# EasyEDA Pro project ProPrj_Avaota A1 八核 AIoT 开发板_2024-05-20.epro, board 点位_TOP (continued)
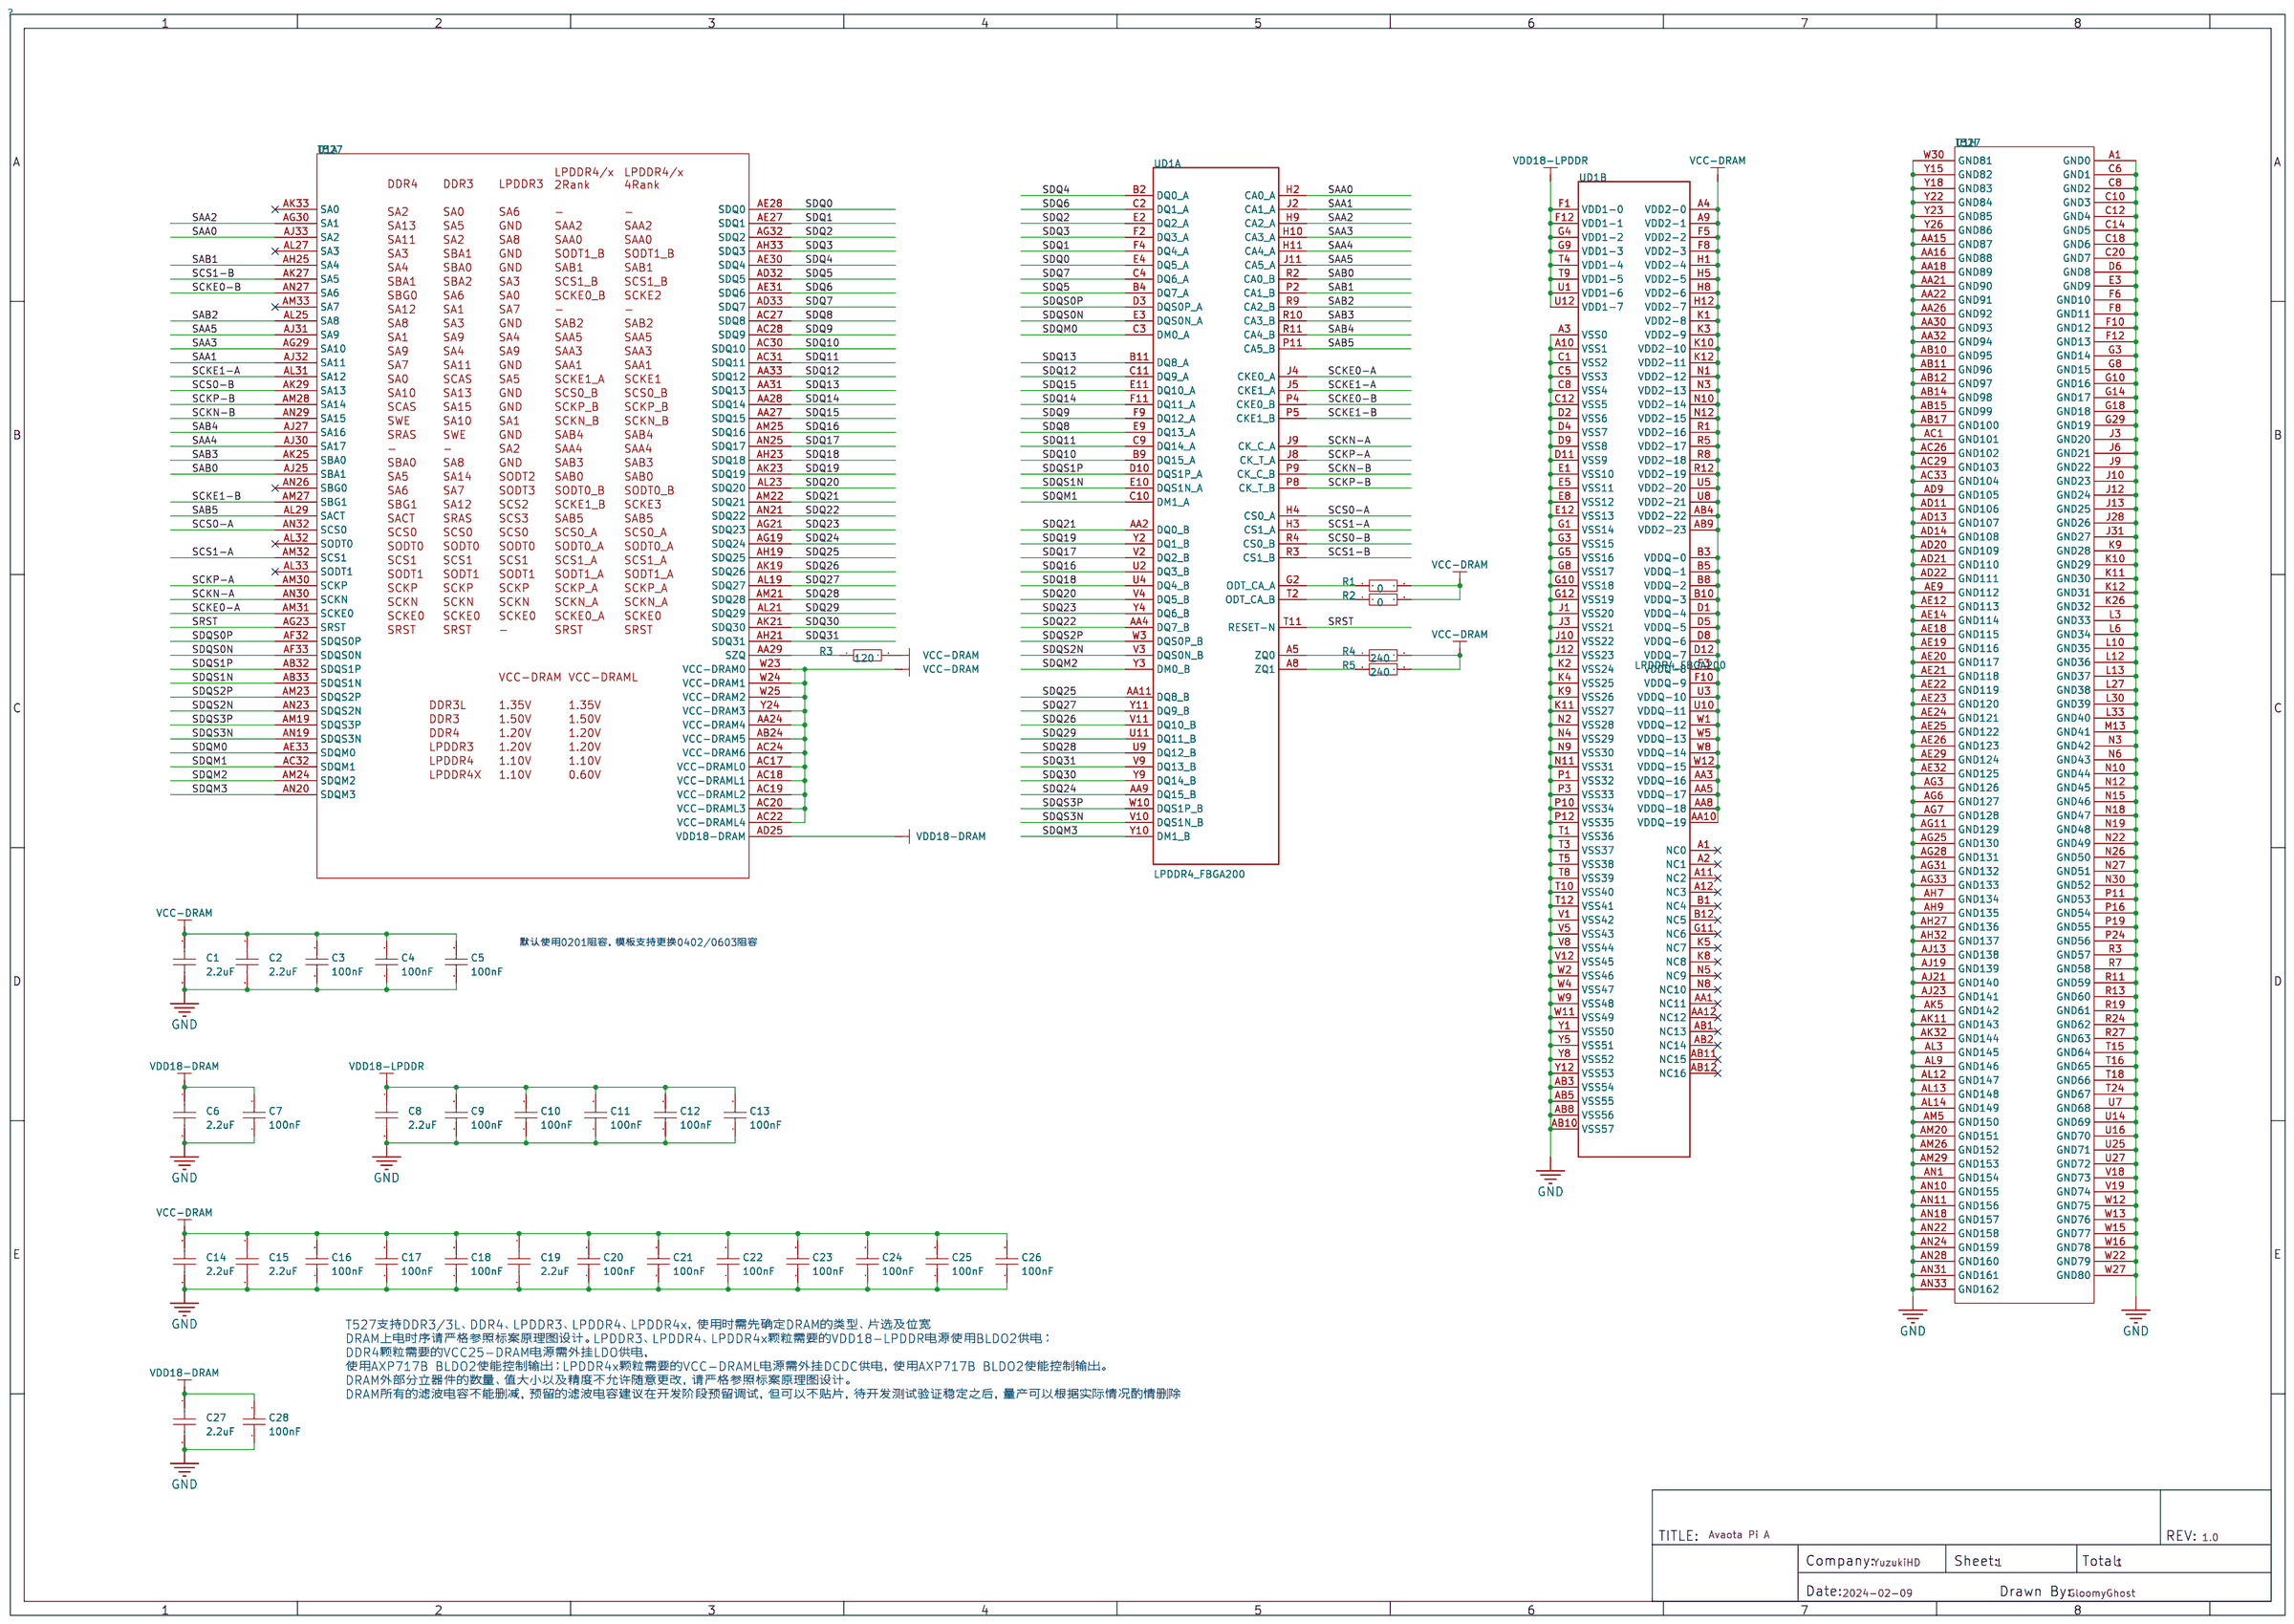
[diagram p0: schematic sheet]
## Footprints (pads in the part's own frame, mm; a bottom-side part is the same pattern mirrored in y, then rotated) (continued)
  oval 1.199x2.401 hole 1x2: 21(2.505,2.561) 22(2.505,-8.992) 23(-2.555,-11.089) 24(-2.555,0.709)
FAN2510
  round 3.5 hole 3x2.7: 1(28.321,17.053) 2(-2.54,-3.14)
FBGA-153_L13.0-W11.5
  oval 0.2x0.305 smd: A1(-3.25,3.25) A2(-2.75,3.25) A3(-2.25,3.25) A4(-1.75,3.25) A5(-1.25,3.25) A6(-0.75,3.25) A7(-0.25,3.25) A8(0.25,3.25) A9(0.75,3.25) A10(1.25,3.25) A11(1.75,3.25) A12(2.25,3.25) A13(2.75,3.25) A14(3.25,3.25) P1(-3.25,-3.25) P2(-2.75,-3.25) P3(-2.25,-3.25) P4(-1.75,-3.25) P5(-1.25,-3.25) P6(-0.75,-3.25) P7(-0.25,-3.25) P8(0.25,-3.25) P9(0.75,-3.25) P10(1.25,-3.25) P11(1.75,-3.25) P12(2.25,-3.25) P13(2.75,-3.25) P14(3.25,-3.25)
  oval 0.305x0.2 smd: B1(-3.25,2.75) B14(3.25,2.75) C1(-3.25,2.25) C14(3.25,2.25) D1(-3.25,1.75) D14(3.25,1.75) E1(-3.25,1.25) E14(3.25,1.25) F1(-3.25,0.75) F14(3.25,0.75) G1(-3.25,0.25) G14(3.25,0.25) H1(-3.25,-0.25) H14(3.25,-0.25) J1(-3.25,-0.75) J14(3.25,-0.75) K1(-3.25,-1.25) K14(3.25,-1.25) L1(-3.25,-1.75) L14(3.25,-1.75) M1(-3.25,-2.25) M14(3.25,-2.25) N1(-3.25,-2.75) N14(3.25,-2.75)
  round 0.25 smd: B2(-2.75,2.75) B3(-2.25,2.75) B4(-1.75,2.75) B5(-1.25,2.75) B6(-0.75,2.75) B7(-0.25,2.75) B8(0.25,2.75) B9(0.75,2.75) B10(1.25,2.75) B11(1.75,2.75) B12(2.25,2.75) B13(2.75,2.75) C2(-2.75,2.25) C3(-2.25,2.25) C4(-1.75,2.25) C5(-1.25,2.25) C6(-0.75,2.25) C7(-0.25,2.25) C8(0.25,2.25) C9(0.75,2.25) C10(1.25,2.25) C11(1.75,2.25) C12(2.25,2.25) C13(2.75,2.25) D2(-2.75,1.75) D3(-2.25,1.75) D4(-1.75,1.75) D12(2.25,1.75) D13(2.75,1.75) E2(-2.75,1.25) E3(-2.25,1.25) E5(-1.25,1.25) E6(-0.75,1.25) E7(-0.25,1.25) E8(0.25,1.25) E9(0.75,1.25) E10(1.25,1.25) E12(2.25,1.25) E13(2.75,1.25) F2(-2.75,0.75) F3(-2.25,0.75) F5(-1.25,0.75) F10(1.25,0.75) F12(2.25,0.75) F13(2.75,0.75) G2(-2.75,0.25) G3(-2.25,0.25) G5(-1.25,0.25) G10(1.25,0.25) G12(2.25,0.25) G13(2.75,0.25) H2(-2.75,-0.25) H3(-2.25,-0.25) H5(-1.25,-0.25) H10(1.25,-0.25) H12(2.25,-0.25) H13(2.75,-0.25) J2(-2.75,-0.75) J3(-2.25,-0.75) J5(-1.25,-0.75) J10(1.25,-0.75) J12(2.25,-0.75) J13(2.75,-0.75) K2(-2.75,-1.25) K3(-2.25,-1.25) K5(-1.25,-1.25) K6(-0.75,-1.25) K7(-0.25,-1.25) K8(0.25,-1.25) K9(0.75,-1.25) K10(1.25,-1.25) K12(2.25,-1.25) K13(2.75,-1.25) L2(-2.75,-1.75) L3(-2.25,-1.75) L12(2.25,-1.75) L13(2.75,-1.75) M2(-2.75,-2.25) M3(-2.25,-2.25) M4(-1.75,-2.25) M5(-1.25,-2.25) M6(-0.75,-2.25) M7(-0.25,-2.25) M8(0.25,-2.25) M9(0.75,-2.25) M10(1.25,-2.25) M11(1.75,-2.25) M12(2.25,-2.25) M13(2.75,-2.25) N2(-2.75,-2.75) N3(-2.25,-2.75) N4(-1.75,-2.75) N5(-1.25,-2.75) N6(-0.75,-2.75) N7(-0.25,-2.75) N8(0.25,-2.75) N9(0.75,-2.75) N10(1.25,-2.75) N11(1.75,-2.75) N12(2.25,-2.75) N13(2.75,-2.75)
HDMI-SMD_HDMI-001C
  round 0.8 hole 0.55: 1(5.3,0.5) 2(4.731,-0.5) 3(4.145,0.5) 4(3.575,-0.5) 5(2.99,0.5) 6(2.419,-0.5) 7(1.835,0.5) 8(1.264,-0.5) 9(0.68,0.5) 10(0.107,-0.5) 11(-0.475,0.5) 12(-1.049,-0.5) 13(-1.63,0.5) 14(-2.205,-0.5) 15(-2.785,0.5) 16(-3.361,-0.5) 17(-3.94,0.5) 18(-4.517,-0.5) 19(-5.095,0.5)
  oval 3.2x1.4 hole 2.7x0.9: 20(-6.05,3.25) 20(-2.95,-3.25) 20(3.45,3.25) 20(6.05,-3.25)
HDR-TH_40P-P2.54-V-M-R2-C20-S2.54
  rect 1.575x1.8 hole 1.1: 1(-24.13,-1.27)
  round 1.8 hole 1.1: 2(-24.13,1.27) 3(-21.59,-1.27) 4(-21.59,1.27) 5(-19.05,-1.27) 6(-19.05,1.27) 7(-16.51,-1.27) 8(-16.51,1.27) 9(-13.97,-1.27) 10(-13.97,1.27) 11(-11.43,-1.27) 12(-11.43,1.27) 13(-8.89,-1.27) 14(-8.89,1.27) 15(-6.35,-1.27) 16(-6.35,1.27) 17(-3.81,-1.27) 18(-3.81,1.27) 19(-1.27,-1.27) 20(-1.27,1.27) 21(1.27,-1.27) 22(1.27,1.27) 23(3.81,-1.27) 24(3.81,1.27) 25(6.35,-1.27) 26(6.35,1.27) 27(8.89,-1.27) 28(8.89,1.27) 29(11.43,-1.27) 30(11.43,1.27) 31(13.97,-1.27) 32(13.97,1.27) 33(16.51,-1.27) 34(16.51,1.27) 35(19.05,-1.27) 36(19.05,1.27) 37(21.59,-1.27) 38(21.59,1.27) 39(24.13,-1.27) 40(24.13,1.27)
IND-SMD_L2.0-W1.6
  rect 1x1.72 smd: 1(0.828,0) 2(-0.828,0)
ind-smd_l2.0-w1.6_1
  rect 1.169x1.956 smd: 1(0.889,0) 2(-0.889,0)
IND-SMD_L7.0-W6.6
  rect 2.4x3.2 smd: 1(-3,0) 2(3,0)
IPEX-SMD_BWIPX-1-001E
  rect 1.05x1 smd: 1(-0.762,0)
  rect 2.2x1.05 smd: 2(0.762,-1.475) 3(0.762,1.475)
LED-SMD_4P-L2.0-W2.0-TL_WS2812B-2020
  rect 0.9x0.7 smd: 1(-0.915,0.55) 2(-0.915,-0.55) 3(0.915,-0.55) 4(0.915,0.55)
LGA-44_L12.0-W12.0-P0.90
  rect 1.177x0.6 smd: 1(-5.843,4.5) 2(-5.843,3.6) 3(-5.843,2.7) 4(-5.843,1.8) 5(-5.843,0.9) 6(-5.843,0) 7(-5.843,-0.9) 8(-5.843,-1.8) 9(-5.843,-2.7) 10(-5.843,-3.6) 11(-5.843,-4.5) 23(5.843,-4.5) 24(5.843,-3.6) 25(5.843,-2.7) 26(5.843,-1.8) 27(5.843,-0.9) 28(5.843,0) 29(5.843,0.9) 30(5.843,1.8) 31(5.843,2.7) 32(5.843,3.6) 33(5.843,4.5)
  rect 0.6x1.177 smd: 12(-4.5,-5.843) 13(-3.6,-5.843) 14(-2.7,-5.843) 15(-1.8,-5.843) 16(-0.9,-5.843) 17(0,-5.843) 18(0.9,-5.843) 19(1.8,-5.843) 20(2.7,-5.843) 21(3.6,-5.843) 22(4.5,-5.843) 34(4.5,5.843) 35(3.6,5.843) 36(2.7,5.843) 37(1.8,5.843) 38(0.9,5.843) 39(0,5.843) 40(-0.9,5.843) 41(-1.8,5.843) 42(-2.7,5.843) 43(-3.6,5.843) 44(-4.5,5.843)
osc-smd_l3.2-w1.5 nsk
  rect 1.05x1.7 smd: 1(-1.275,0) 2(1.275,0)
Pad_e551
  round 5 hole 3.3: 54(0,0)
Pad_e553
  round 5 hole 3.3: 54(0,0)
Pad_e554
  round 5 hole 3.3: 54(0,0)
Pad_e555
  round 5 hole 3.3: 54(0,0)
Pad_e563
  round 5 hole 3.3: 54(0,0)
QFN-20_L3.0-W3.0-P0.40-BL-EP1.5
  rect 0.2x0.665 smd: 1(-0.8,-1.407) 2(-0.4,-1.407) 3(0,-1.407) 4(0.4,-1.407) 5(0.8,-1.407) 11(0.8,1.407) 12(0.4,1.407) 13(0,1.407) 14(-0.4,1.407) 15(-0.8,1.407)
  rect 0.665x0.2 smd: 6(1.407,-0.8) 7(1.407,-0.4) 8(1.407,0) 9(1.407,0.4) 10(1.407,0.8) 16(-1.407,0.8) 17(-1.407,0.4) 18(-1.407,0) 19(-1.407,-0.4) 20(-1.407,-0.8)
  rect 1.5x1.5 smd: 21(0,0)
QFN-52_L6.0-W6.0-P0.40-BL-EP3.4-1
  custom 0.2x0.585 smd: 1(-2.4,-2.917) 13(2.4,-2.917) 27(2.4,2.917) 39(-2.4,2.917)
  rect 0.2x0.585 smd: 2(-2,-2.917) 3(-1.6,-2.917) 4(-1.2,-2.917) 5(-0.8,-2.917) 6(-0.4,-2.917) 7(0,-2.917) 8(0.4,-2.917) 9(0.8,-2.917) 10(1.2,-2.917) 11(1.6,-2.917) 12(2,-2.917) 28(2,2.917) 29(1.6,2.917) 30(1.2,2.917) 31(0.8,2.917) 32(0.4,2.917) 33(0,2.917) 34(-0.4,2.917) 35(-0.8,2.917) 36(-1.2,2.917) 37(-1.6,2.917) 38(-2,2.917)
  custom 0.585x0.2 smd: 14(2.917,-2.4) 26(2.917,2.4) 40(-2.917,2.4) 52(-2.917,-2.4)
  rect 0.585x0.2 smd: 15(2.917,-2) 16(2.917,-1.6) 17(2.917,-1.2) 18(2.917,-0.8) 19(2.917,-0.4) 20(2.917,0) 21(2.917,0.4) 22(2.917,0.8) 23(2.917,1.2) 24(2.917,1.6) 25(2.917,2) 41(-2.917,2) 42(-2.917,1.6) 43(-2.917,1.2) 44(-2.917,0.8) 45(-2.917,0.4) 46(-2.917,0) 47(-2.917,-0.4) 48(-2.917,-0.8) 49(-2.917,-1.2) 50(-2.917,-1.6) 51(-2.917,-2)
  rect 3.4x3.4 smd: 53(0,0)
r0201 nsk
  rect 0.303x0.324 smd: 1(-0.241,0) 2(0.241,0)
R0402-NSK
  rect 0.5x0.559 smd: 1(-0.457,0) 2(0.458,0)
R0603 NSK
  rect 0.806x0.864 smd: 1(-0.753,0) 2(0.753,0)
RGBLED_0807
  rect 0.91x1.778 smd: 1(-0.914,0) 2(0.94,0)
RJ45-TH_HR911130A
  round 1.7 hole 1.1: 11(6.604,6.924) 12(4.064,6.924) 13(-4.064,6.924) 14(-6.604,6.924)
  rect 1.524x1.524 hole 0.909: P1(5.832,-6.924)
  round 1.524 hole 0.909: P2(4.549,-4.379) P3(3.18,-6.919) P4(2.009,-4.379) P5(0.64,-6.919) P6(-0.531,-4.379) P7(-1.9,-6.919) P8(-3.071,-4.379) P9(-4.44,-6.919) P10(-5.611,-4.379)
  round 2.159 hole 1.651: SHIELD0(-8.001,-1.079) SHIELD1(8.001,-1.079)
SENSOR-SMD_IRM-H638T-TR2-TL
  rect 1.5x0.9 smd: 1(-2.95,1.27) 2(-2.95,-1.27) 3(2.95,-1.27) 4(2.921,1.27)
SLP2510P8_L2.5-W1.0-P0.50-BL
  rect 0.2x0.68 smd: 1(-1,-0.44) 2(-0.5,-0.44) 4(0.5,-0.44) 5(1,-0.44) 6(1,0.44) 7(0.5,0.44) 9(-0.5,0.44) 10(-1,0.44)
  rect 0.4x0.68 smd: 3(0.001,-0.44) 8(0.001,0.44)
SMA_L4.4-W2.8-LS5.4-R-RD
  rect 2.062x1.539 smd: 1(2.503,0) 2(-2.503,0)
SMC_L6.9-W5.9-LS7.9-BI
  rect 3.03x3.82 smd: 1(-3.435,0) 2(3.435,0)
SOD-323_L1.8-W1.3-LS2.5-RD
  rect 1x0.75 smd: 1(-1.173,0) 2(1.173,0)
SOD-523_L1.2-W0.8-LS1.6-RD-1 NSK
  rect 0.6x0.36 smd: 1(-0.635,0) 2(0.635,0)
SOIC-8_L5.0-W4.0-P1.27-LS6.0-BL-EP2.0
  oval 0.574x2.038 smd: 1(-1.905,-2.769) 2(-0.635,-2.769) 3(0.635,-2.769) 4(1.905,-2.769) 5(1.905,2.769) 6(0.635,2.769) 7(-0.635,2.769) 8(-1.905,2.769)
  rect 2x2 smd: 9(0,0)
SOT-23-3_L2.9-W1.3-P1.90-LS2.4-BR
  rect 1.25x0.7 smd: 1(1,-0.95) 2(1,0.95) 3(-1,0)
SOT-23-5_L3.0-W1.7-P0.95-LS2.8-BL
  rect 0.49x1.157 smd: 1(-0.95,-1.153) 2(0,-1.153) 3(0.95,-1.153)
  rect 0.49x1.175 smd: 4(0.95,1.153) 5(-0.95,1.153)
SW-SMD_4P-L4.2-W3.4-P2.15-LS4.5-TL
  rect 1.05x0.7 smd: 1(-2.1,1.075) 2(2.1,1.075) 3(-2.1,-1.075) 4(2.1,-1.075)
t527-bga664
  round 0.229 smd: A1(-8,8) A2(-7.5,8) A3(-7,8) A4(-6.5,8) A5(-6,8) A6(-5.5,8) A8(-4.5,8) A10(-3.5,8) A12(-2.5,8) A14(-1.5,8) A16(-0.5,8) A18(0.5,8) A20(1.5,8) A22(2.5,8) A24(3.5,8) A26(4.5,8) A28(5.5,8) A29(6,8) A30(6.5,8) A31(7,8) A32(7.5,8) A33(8,8) AA1(-8,-2) AA2(-7.5,-2) AA3(-7,-2) AA4(-6.5,-2) AA5(-6,-2) AA6(-5.5,-2) AA7(-5,-2) AA9(-4,-2) AA12(-2.5,-2) AA13(-2,-2) AA15(-1,-2) AA16(-0.5,-2) AA18(0.5,-2) AA19(1,-2) AA21(2,-2) AA22(2.5,-2) AA24(3.5,-2) AA26(4.5,-2) AA27(5,-2) AA28(5.5,-2) AA29(6,-2) AA30(6.5,-2) AA31(7,-2) AA32(7.5,-2) AA33(8,-2) AB2(-7.5,-2.501) AB3(-7,-2.5) AB9(-4,-2.501) AB10(-3.5,-2.5) AB11(-3,-2.5) AB12(-2.5,-2.5) AB13(-2,-2.5) AB14(-1.5,-2.5) AB15(-1,-2.5) AB17(0,-2.5) AB24(3.5,-2.5) AB32(7.5,-2.501) AB33(8,-2.5) AC1(-8,-3) AC2(-7.5,-3) AC3(-7,-3) AC4(-6.5,-3) AC5(-6,-3) AC6(-5.5,-3) AC7(-5,-3) AC9(-4,-3) AC15(-1,-3) AC17(0,-3) AC18(0.5,-3) AC19(1,-3) AC20(1.5,-3) AC22(2.5,-3) AC24(3.5,-3) AC26(4.5,-3) AC27(5,-3) AC28(5.5,-3) AC29(6,-3) AC30(6.5,-3) AC31(7,-3) AC32(7.5,-3) AC33(8,-3) AD1(-8,-3.5) AD2(-7.5,-3.5) AD9(-4,-3.5) AD11(-3,-3.5) AD13(-2,-3.5) AD14(-1.5,-3.5) AD15(-1,-3.5) AD20(1.5,-3.5) AD21(2,-3.5) AD22(2.5,-3.5) AD25(4,-3.5) AD32(7.5,-3.5) AD33(8,-3.5) AE1(-8,-4) AE2(-7.5,-4) AE3(-7,-4) AE4(-6.5,-4) AE5(-6,-4) AE6(-5.5,-4) AE7(-5,-4) AE9(-4,-4) AE11(-3,-4) AE12(-2.501,-4) AE13(-2,-4) AE14(-1.5,-4) AE16(-0.5,-4) AE18(0.5,-4) AE19(1,-4) AE20(1.5,-4) AE21(2,-4) AE22(2.501,-4) AE23(3,-4) AE24(3.5,-4) AE25(4,-4) AE26(4.5,-4) AE27(5,-4) AE28(5.5,-4) AE29(6,-4) AE30(6.5,-4) AE31(7,-4) AE32(7.5,-4) AE33(8,-4) AF1(-8,-4.5) AF2(-7.5,-4.5) AF32(7.5,-4.5) AF33(8,-4.5) AG1(-8,-5) AG2(-7.5,-5) AG3(-7,-5) AG4(-6.5,-5) AG5(-6,-5) AG6(-5.5,-5) AG7(-5,-5) AG9(-4,-5) AG11(-3,-5) AG13(-2,-5) AG15(-1,-5) AG17(0,-5) AG19(1,-5) AG21(2,-5) AG23(3,-5) AG25(4,-5) AG28(5.5,-5) AG29(6,-5) AG30(6.5,-5) AG31(7,-5) AG32(7.5,-5) AG33(8,-5) AH1(-8,-5.5) AH2(-7.5,-5.5) AH7(-5,-5.5) AH9(-4,-5.5) AH11(-3,-5.5) AH13(-2,-5.5) AH15(-1,-5.5) AH17(0,-5.5) AH19(1,-5.5) AH21(2,-5.5) AH23(3,-5.5) AH25(4,-5.5) AH27(5,-5.5) AH32(7.5,-5.5) AH33(8,-5.5) AJ1(-8,-6) AJ2(-7.5,-6) AJ3(-7,-6) AJ4(-6.5,-6) AJ5(-6,-6) AJ7(-5,-6) AJ9(-4,-6) AJ11(-3,-6) AJ13(-2,-6) AJ15(-1,-6) AJ17(0,-6) AJ19(1,-6) AJ21(2,-6) AJ23(3,-6) AJ25(4,-6) AJ27(5,-6) AJ30(6.5,-6) AJ31(7,-6) AJ32(7.5,-6) AJ33(8,-6) AK1(-8,-6.5) AK2(-7.5,-6.5) AK5(-6,-6.5) AK7(-5,-6.5) AK9(-4,-6.5) AK11(-3,-6.5) AK13(-2,-6.5) AK15(-1,-6.5) AK17(0,-6.5) AK19(1,-6.5) AK21(2,-6.5) AK23(3,-6.5) AK25(4,-6.5) AK27(5,-6.5) AK29(6,-6.5) AK32(7.5,-6.5) AK33(8,-6.5) AL1(-8,-7) AL2(-7.5,-7) AL3(-7,-7) AL5(-6,-7) AL7(-5,-7) AL9(-4,-7) AL11(-3,-7) AL12(-2.5,-7) AL13(-2,-7) AL14(-1.5,-7) AL15(-1,-7) AL16(-0.5,-7) AL17(0,-7) AL19(1,-7) AL21(2,-7) AL23(3,-7) AL25(4,-7) AL27(5,-7) AL29(6,-7) AL31(7,-7) AL32(7.5,-7) AL33(8,-7) AM1(-8,-7.5) AM2(-7.5,-7.5) AM3(-7,-7.5) AM4(-6.5,-7.5) AM5(-6,-7.5) AM6(-5.5,-7.5) AM7(-5,-7.5) AM8(-4.5,-7.5) AM9(-4,-7.5) AM10(-3.5,-7.5) AM11(-3,-7.5) AM12(-2.501,-7.5) AM13(-2,-7.5) AM14(-1.5,-7.5) AM15(-1,-7.5) AM16(-0.5,-7.5) AM17(0,-7.5) AM18(0.5,-7.5) AM19(1,-7.5) AM20(1.5,-7.5) AM21(2,-7.5) AM22(2.501,-7.5) AM23(3,-7.5) AM24(3.5,-7.5) AM25(4,-7.5) AM26(4.5,-7.5) AM27(5,-7.5) AM28(5.5,-7.5) AM29(6,-7.5) AM30(6.5,-7.5) AM31(7,-7.5) AM32(7.5,-7.5) AM33(8,-7.5) AN1(-8,-8) AN2(-7.5,-8) AN3(-7,-8) AN4(-6.5,-8) AN5(-6,-8) AN6(-5.5,-8) AN7(-5,-8) AN8(-4.5,-8) AN9(-4,-8) AN10(-3.5,-8) AN11(-3,-8) AN13(-2,-8) AN15(-1,-8) AN17(0,-8) AN18(0.5,-8) AN19(1,-8) AN20(1.5,-8) AN21(2,-8) AN22(2.5,-8) AN23(3,-8) AN24(3.5,-8) AN25(4,-8) AN26(4.5,-8) AN27(5,-8) AN28(5.5,-8) AN29(6,-8) AN30(6.5,-8) AN31(7,-8) AN32(7.5,-8) AN33(8,-8) B1(-8,7.5) B2(-7.5,7.5) B3(-7,7.5) B4(-6.5,7.5) B5(-6,7.5) B6(-5.5,7.5) B7(-5,7.5) B8(-4.5,7.5) B9(-4,7.5) B10(-3.5,7.5) B11(-3,7.5) B12(-2.501,7.5) B13(-2,7.5) B14(-1.5,7.5) B15(-1,7.5) B16(-0.5,7.5) B17(0,7.5) B18(0.5,7.5) B19(1,7.5) B20(1.5,7.5) B21(2,7.5) B22(2.501,7.5) B23(3,7.5) B24(3.5,7.5) B25(4,7.5) B26(4.5,7.5) B27(5,7.5) B28(5.5,7.5) B29(6,7.5) B30(6.5,7.5) B31(7,7.5) B32(7.5,7.5) B33(8,7.5) C1(-8,7) C2(-7.5,7) C3(-7,7) C4(-6.5,7) C6(-5.5,7) C7(-5,7) C8(-4.5,7) C9(-4,7) C10(-3.5,7) C11(-3,7) C12(-2.5,7) C13(-2,7) C14(-1.5,7) C15(-1,7) C16(-0.5,7) C17(0,7) C18(0.5,7) C19(1,7) C20(1.5,7) C21(2,7) C22(2.5,7) C23(3,7) C24(3.5,7) C25(4,7) C26(4.5,7) C27(5,7) C28(5.5,7) C29(6,7) C30(6.5,7) C31(7,7) C32(7.5,7) C33(8,7) D1(-8,6.5) D2(-7.5,6.5) D6(-5.5,6.5) D8(-4.5,6.5) D10(-3.5,6.5) D12(-2.5,6.5) D14(-1.5,6.5) D16(-0.5,6.5) D18(0.5,6.5) D20(1.5,6.5) D22(2.5,6.5) D24(3.5,6.5) D26(4.5,6.5) D28(5.5,6.5) D32(7.5,6.5) D33(8,6.5) E1(-8,6) E2(-7.5,6) E3(-7,6) E4(-6.5,6) E5(-6,6) E6(-5.5,6) E8(-4.5,6) E10(-3.5,6) E12(-2.5,6) E14(-1.5,6) E16(-0.5,6) E18(0.5,6) E20(1.5,6) E22(2.5,6) E24(3.5,6) E26(4.5,6) E28(5.5,6) E29(6,6) E30(6.5,6) E31(7,6) E32(7.5,6) E33(8,6) F1(-8,5.5) F2(-7.5,5.5) F6(-5.5,5.5) F8(-4.5,5.5) F10(-3.5,5.5) F12(-2.5,5.5) F14(-1.5,5.5) F16(-0.5,5.5) F18(0.5,5.5) F20(1.5,5.5) F22(2.5,5.5) F24(3.5,5.5) F26(4.5,5.5) F28(5.5,5.5) F32(7.5,5.5) F33(8,5.5) G1(-8,5) G2(-7.5,5) G3(-7,5) G4(-6.5,5) G5(-6,5) G6(-5.5,5) G8(-4.5,5) G10(-3.5,5) G12(-2.5,5) G14(-1.5,5) G16(-0.5,5) G18(0.5,5) G20(1.5,5) G22(2.5,5) G24(3.5,5) G26(4.5,5) G28(5.5,5) G29(6,5) G30(6.5,5) G31(7,5) G32(7.5,5) G33(8,5) H2(-7.5,4.5) H3(-7,4.5) H24(3.5,4.5) H31(7,4.5) H32(7.5,4.5) J1(-8,4) J2(-7.5,4) J3(-7,4) J4(-6.5,4) J5(-6,4) J6(-5.5,4) J7(-5,4) J9(-4,4) J10(-3.5,4) J12(-2.501,4) J13(-2,4) J15(-1,4) J16(-0.5,4) J17(0,4) J18(0.5,4) J19(1,4) J21(2,4) J22(2.501,4) J23(3,4) J26(4.5,4) J28(5.5,4) J29(6,4) J30(6.5,4) J31(7,4) J32(7.5,4) J33(8,4) K2(-7.5,3.5) K3(-7,3.5) K9(-4,3.5) K10(-3.5,3.5) K11(-3,3.5) K12(-2.5,3.5) K13(-2,3.5) K15(-1,3.5) K16(-0.5,3.5) K19(1,3.5) K21(2,3.5) K22(2.5,3.5) K24(3.5,3.5) K25(4,3.5) K26(4.5,3.5) K31(7,3.5) K32(7.5,3.5) L1(-8,3) L2(-7.5,3) L3(-7,3) L4(-6.5,3) L5(-6,3) L6(-5.5,3) L7(-5,3) L9(-4,3) L10(-3.5,3) L12(-2.5,3) L13(-2,3) L15(-1,3) L16(-0.5,3) L17(0,3) L18(0.5,3) L19(1,3) L21(2,3) L22(2.5,3) L24(3.5,3) L26(4.5,3) L27(5,3) L28(5.5,3) L29(6,3) L30(6.5,3) L31(7,3) L32(7.5,3) L33(8,3) M2(-7.5,2.501) M3(-7,2.5) M10(-3.5,2.5) M13(-2,2.5) M16(-0.5,2.5) M18(0.5,2.5) M19(1,2.5) M21(2,2.5) M22(2.5,2.5) M31(7,2.5) M32(7.5,2.501) N1(-8,2) N2(-7.5,2) N3(-7,2) N4(-6.5,2) N5(-6,2) N6(-5.5,2) N7(-5,2) N9(-4,2) N10(-3.5,2) N12(-2.5,2) N13(-2,2) N15(-1,2) N18(0.5,2) N19(1,2) N21(2,2) N22(2.5,2) N24(3.5,2) N26(4.5,2) N27(5,2) N28(5.5,2) N29(6,2) N30(6.5,2) N31(7,2) N32(7.5,2) N33(8,2) P2(-7.5,1.5) P3(-7,1.5) P9(-4,1.5) P11(-3,1.5) P13(-2,1.5) P16(-0.5,1.5) P18(0.5,1.5) P19(1,1.5) P21(2,1.5) P22(2.5,1.5) P24(3.5,1.5) P31(7,1.5) P32(7.5,1.5) R1(-8,1) R2(-7.5,1) R3(-7,1) R4(-6.5,1) R5(-6,1) R6(-5.5,1) R7(-5,1) R11(-3,1) R13(-2,1) R15(-1,1) R17(0,1) R18(0.5,1) R19(1,1) R22(2.5,1) R24(3.5,1) R26(4.5,1) R27(5,1) R28(5.5,1) R29(6,1) R30(6.5,1) R31(7,1) R32(7.5,1) R33(8,1) T2(-7.5,0.5) T3(-7,0.5) T9(-4,0.5) T11(-3,0.5) T13(-2,0.5) T15(-1,0.5) T16(-0.5,0.5) T18(0.5,0.5) T19(1,0.5) T21(2,0.5) T22(2.5,0.5) T24(3.5,0.5) T31(7,0.5) T32(7.5,0.5) U1(-8,0) U2(-7.5,0) U3(-7,0) U4(-6.5,0) U5(-6,0) U6(-5.5,0) U7(-5,0) U8(-4.5,0) U10(-3.5,0) U12(-2.5,0) U13(-2,0) U14(-1.5,0) U16(-0.5,0) U18(0.5,0) U19(1,0) U21(2,0) U22(2.5,0) U25(4,0) U26(4.5,0) U27(5,0) U28(5.5,0) U29(6,0) U30(6.5,0) U31(7,0) U32(7.5,0) U33(8,0) V2(-7.5,-0.5) V3(-7,-0.5) V18(0.5,-0.5) V19(1,-0.5) V31(7,-0.5) V32(7.5,-0.5) W1(-8,-1) W2(-7.5,-1) W3(-7,-1) W4(-6.5,-1) W5(-6,-1) W6(-5.5,-1) W7(-5,-1) W9(-4,-1) W10(-3.5,-1) W12(-2.5,-1) W13(-2,-1) W15(-1,-1) W16(-0.5,-1) W19(1,-1) W21(2,-1) W22(2.5,-1) W23(3,-1) W24(3.5,-1) W25(4,-1) W27(5,-1) W28(5.5,-1) W29(6,-1) W30(6.5,-1) W31(7,-1) W32(7.5,-1) W33(8,-1) Y2(-7.5,-1.5) Y3(-7,-1.5) Y9(-4,-1.5) Y10(-3.5,-1.5) Y12(-2.5,-1.5) Y13(-2,-1.5) Y15(-1,-1.5) Y18(0.5,-1.5) Y19(1,-1.5) Y21(2,-1.5) Y22(2.5,-1.5) Y23(3,-1.5) Y24(3.5,-1.5) Y26(4.5,-1.5) Y31(7,-1.5) Y32(7.5,-1.5)
TFT_1.14寸_0.7MM-13P
  oval 4x0.35 smd: 1(2.65,4.2) 2(2.65,3.5) 3(2.65,2.8) 4(2.65,2.1) 5(2.65,1.4) 6(2.65,0.7) 7(2.65,0) 8(2.65,-0.7) 9(2.65,-1.4) 10(2.65,-2.1) 11(2.65,-2.8) 12(2.65,-3.5) 13(2.65,-4.2)
USB-A-TH_XUNPU_USB-303WSD-BRY
  round 1.1 hole 0.7: 1(-3.5,-1.35) 2(-1,-1.35) 3(1,-1.35) 4(3.5,-1.35) 5(4,0.15) 6(2,0.15) 7(0,0.15) 8(-2,0.15) 9(-4,0.15) 10(-3.5,1.85) 11(-1,1.85) 12(1,1.85) 13(3.5,1.85) 14(4,3.35) 15(2,3.35) 16(0,3.35) 17(-2,3.35) 18(-4,3.35)
  round 3.2 hole 2.4: 19(6.57,-3.35) 20(6.57,2.33) 21(-6.57,2.33) 22(-6.57,-3.35)
USB-C-SMD_TYPEC-304-BCP16-1
  oval 1x2.1 hole 0.6x1.7: 12(-4.32,1.633) 13(4.32,1.633)
  oval 1x1.6 hole 0.6x1.2: 14(-4.32,-2.547) 15(4.32,-2.547)
  rect 0.55x1.45 smd: A1B12(-3.225,2.547) A4B9(-2.45,2.547) B1A12(3.225,2.547) B4A9(2.45,2.547)
  rect 0.3x1.45 smd: A5(-1.25,2.547) A6(-0.25,2.547) A7(0.25,2.547) A8(1.25,2.547) B5(1.75,2.547) B6(0.75,2.547) B7(-0.75,2.547) B8(-1.75,2.547)
WQFN-40_L5.0-W5.0-P0.4-BL-EP
  oval 0.2x0.8 smd: 1(-1.801,-2.499) 2(-1.399,-2.499) 3(-1.001,-2.499) 4(-0.6,-2.499) 5(-0.201,-2.499) 6(0.201,-2.499) 7(0.6,-2.499) 8(1.001,-2.499) 9(1.399,-2.499) 10(1.801,-2.499) 21(1.801,2.499) 22(1.399,2.499) 23(1.001,2.499) 24(0.6,2.499) 25(0.201,2.499) 26(-0.201,2.499) 27(-0.6,2.499) 28(-1.001,2.499) 29(-1.399,2.499) 30(-1.801,2.499)
  oval 0.8x0.2 smd: 11(2.499,-1.801) 12(2.499,-1.399) 13(2.499,-1.001) 14(2.499,-0.6) 15(2.499,-0.201) 16(2.499,0.201) 17(2.499,0.6) 18(2.499,1.001) 19(2.499,1.399) 20(2.499,1.801) 31(-2.499,1.801) 32(-2.499,1.399) 33(-2.499,1.001) 34(-2.499,0.6) 35(-2.499,0.201) 36(-2.499,-0.201) 37(-2.499,-0.6) 38(-2.499,-1.001) 39(-2.499,-1.399) 40(-2.499,-1.801)
  rect 3.8x3.8 smd: 41(0,0)

## Nets
AGND: U14.AE3
GND: C1.1 C2.1 C3.1 C5.1 C6.1 C7.1 C8.1 C10.2 C11.2 C12.2 C15.1 C16.1 C17.2 C18.1 C25.1 C27.1 C28.1 C31.1 C33.1 C35.1 C43.2 C44.1 C45.1 C51.2 C52.2 C53.2 C54.2 C55.2 C59.2 C60.1 C61.2 C62.1 C63.2 C64.1 C65.2 C66.1 C69.2 C70.1 C71.2 C72.1 C73.2 C74.1 C80.1 C81.1 C87.1 C88.2 C89.1 C95.1 C96.1 C97.1 C98.1 C99.1 C100.1 C101.1 C131.1 C136.1 C139.1 C140.1 C146.1 C147.2 C148.1 C149.1 C150.1 C157.1 C158.1 C159.1 C160.1 C179.1 C180.1 C189.1 C210.1 C218.1 C221.1 C222.1 C244.1 C245.1 C249.2 C250.2 C251.1 C252.1 C253.2 C254.2 C256.2 C257.1 C258.2 C259.1 C260.2 C261.2 C262.2 C263.2 C264.2 C265.2 C266.2 C267.2 C268.1 C269.2 C270.2 C271.2 C272.2 C273.2 C274.2 C275.1 C280.1 C281.1 C282.1 C283.1 C284.1 C290.1 C291.1 C292.1 C293.1 CGQ1.1 CGQ1.2 CN3.3 CN3.4 CN4.1 CN4.3 CN4.4 D2.1 D4.1 D5.3 D5.8 D6.3 D6.8 D8.3 D8.8 D10.3 D10.8 D11.3 D11.8 D12.3 D12.8 D13.3 D13.8 D14.3 D14.8 D15.3 D15.8 D24.1 D25.1 D26.1 D27.1 D30.1 D31.1 DC1.2 DC1.3 FEL1.1 H1.6 H1.9 H1.14 H1.20 H1.25 H1.30 H1.34 H1.39 LED1.2 LED2.2 LED3.2 LED4.2 LED5.2 NOREF.54 NOREF#2.54 NOREF#3.54 NOREF#4.54 NOREF#5.54 PWR1.1 R2.1 R6.1 R7.2 R8.1 R13.1 R33.1 R34.1 R35.1 R60.1 R62.1 R82.1 R85.1 R86.1 R93.1 R94.1 R95.1 R96.1 R100.1 R103.1 R104.1 R111.1 R112.1 R113.1 R114.1 R117.2 R118.1 R121.1 R129.1 R130.1 RESET1.1 RF1.2 RF1.3 RJ1.P10 RJ1.SHIELD0 RJ1.SHIELD1 RJ2.P10 RJ2.SHIELD0 RJ2.SHIELD1 TFT1.8 TFT1.11 TFT1.13 U1.2 U2.2 U3.7 U3.9 U4.8 U4.53 U5.9 U5.21 U8.A6 U8.C4 U8.E7 U8.G5 U8.H10 U8.J5 U8.K8 U8.N2 U8.N5 U8.P4 U8.P6 U9.1 U9.3 U9.20 U9.31 U9.33 U9.36 U12.41 U13.41 U14.A1 U14.A32 U14.A33 U14.AA7 U14.AA15 U14.AA16 U14.AA18 U14.AA21 U14.AA22 U14.AA26 U14.AA30 U14.AA32 U14.AB10 U14.AB11 U14.AB12 U14.AB14 U14.AB15 U14.AB17 U14.AC1 U14.AC26 U14.AC29 U14.AC33 U14.AD9 U14.AD11 U14.AD13 U14.AD14 U14.AD20 U14.AD21 U14.AD22 U14.AE9 U14.AE12 U14.AE14 U14.AE18 U14.AE19 U14.AE20 U14.AE21 U14.AE22 U14.AE23 U14.AE24 U14.AE25 U14.AE26 U14.AE29 U14.AE32 U14.AG3 U14.AG6 U14.AG7 U14.AG11 U14.AG25 U14.AG28 U14.AG31 U14.AG33 U14.AH7 U14.AH9 U14.AH27 U14.AH32 U14.AJ13 U14.AJ19 U14.AJ21 U14.AJ23 U14.AK5 U14.AK11 U14.AK32 U14.AL3 U14.AL9 U14.AL12 U14.AL13 U14.AL14 U14.AM5 U14.AM20 U14.AM26 U14.AM29 U14.AN1 U14.AN10 U14.AN11 U14.AN18 U14.AN22 U14.AN24 U14.AN28 U14.AN31 U14.AN33 U14.B21 U14.C6 U14.C8 U14.C10 U14.C12 U14.C14 U14.C18 U14.C20 U14.C21 U14.C22 U14.C24 U14.C26 U14.C28 U14.C30 U14.C31 U14.D6 U14.E3 U14.E29 U14.F6 U14.F8 U14.F10 U14.F12 U14.F22 U14.F24 U14.G3 U14.G8 U14.G10 U14.G14 U14.G18 U14.G26 U14.G28 U14.G29 U14.H24 U14.J3 U14.J6 U14.J9 U14.J10 U14.J12 U14.J13 U14.J17 U14.J21 U14.J22 U14.J23 U14.J26 U14.J28 U14.J31 U14.K9 U14.K10 U14.K11 U14.K12 U14.K15 U14.K16 U14.K21 U14.K22 U14.K24 U14.K25 U14.K26 U14.L3 U14.L6 U14.L10 U14.L12 U14.L13 U14.L16 U14.L19 U14.L24 U14.L27 U14.L30 U14.L33 U14.M13 U14.M16 U14.M18 U14.M19 U14.N3 U14.N6 U14.N10 U14.N12 U14.N15 U14.N18 U14.N19 U14.N22 U14.N26 U14.N27 U14.N30 U14.P11 U14.P16 U14.P19 U14.P24 U14.R3 U14.R7 U14.R11 U14.R13 U14.R19 U14.R24 U14.R27 U14.T15 U14.T16 U14.T18 U14.T24 U14.U7 U14.U14 U14.U16 U14.U25 U14.U27 U14.V18 U14.V19 U14.W12 U14.W13 U14.W15 U14.W16 U14.W22 U14.W27 U14.W30 U14.Y10 U14.Y15 U14.Y18 U14.Y22 U14.Y23 U14.Y26 U15.2 U15.5 U15.8 U15.11 U15.16 U15.19 U15.21 U15.22 U15.23 U15.24 U17.2 UD1.A3 UD1.A10 UD1.AB3 UD1.AB5 UD1.AB8 UD1.AB10 UD1.C1 UD1.C5 UD1.C8 UD1.C12 UD1.D2 UD1.D4 UD1.D9 UD1.D11 UD1.E1 UD1.E5 UD1.E8 UD1.E12 UD1.G1 UD1.G3 UD1.G5 UD1.G8 UD1.G10 UD1.G12 UD1.J1 UD1.J3 UD1.J10 UD1.J12 UD1.K2 UD1.K4 UD1.K9 UD1.K11 UD1.N2 UD1.N4 UD1.N9 UD1.N11 UD1.P1 UD1.P3 UD1.P10 UD1.P12 UD1.T1 UD1.T3 UD1.T5 UD1.T8 UD1.T10 UD1.T12 UD1.V1 UD1.V5 UD1.V8 UD1.V12 UD1.W2 UD1.W4 UD1.W9 UD1.W11 UD1.Y1 UD1.Y5 UD1.Y8 UD1.Y12 USB1.2 USB1.5 USB1.8 USB1.11 USB1.14 USB1.17 USB1.20 USB2.4 USB2.7 USB2.13 USB2.16 USB2.19 USB2.20 USB2.21 USB2.22 USB3.12 USB3.13 USB3.14 USB3.15 USB3.A1B12 USB3.B1A12 X1.2 X1.4 X3.2 X3.4 X4.2 X4.4
VBUS: C27.2 C28.2 C221.2 C222.2 C280.2 D1.2 D3.2 D9.2 H1.2 H1.4 LED2.4 LED3.4 LED4.4 LED5.4 R52.1 R53.1 U4.49 U4.50 U17.5 USB2.1 USB2.10
VBUS-USB: C281.2 C282.2 R120.2 U17.1 USB3.A4B9 USB3.B4A9
VCC-LDO-RTC: C45.2 R9.1 R10.1 U4.35 U14.AE13
VDD-CPUBFB: U5.1 U5.16 U14.R22
VDD-CPULFB: U4.12 U14.AA19
VDD-DNRFB: U5.4 U14.AB13
VDD-SYSFB: U4.34 U14.P18
323-ALDO1: C69.1 U5.15
323-DCDC1/2: C72.2 C74.2 C80.2 C81.2 L6.2 L7.2 U14.T19 U14.T21 U14.T22 U14.U18 U14.U19 U14.U21 U14.U22
323-DCDC3: C87.2 C89.2 L8.2 U14.AA12 U14.AA13 U14.Y12 U14.Y13
323-DLDO1: C71.1 U5.12
323-RTCLDO: C73.1 U5.7
ADCIN0: U14.W9
ADCIN1: U14.W10
ALDO1: C51.1 U4.13
ALDO2: C52.1 U4.14
ALDO3: C53.1 R11.1 R12.1 U4.16 U14.AE11 U14.AG9
ALDO4: C54.1 R19.2 R20.2 R30.2 R31.2 R32.2 U4.17 U14.AB9 U14.AD15 U14.AD25 U14.AG15 U14.W7
ALDO-OUT: U14.AE7
AP-NMI: R10.2 U4.37 U5.11 U14.AM10
AP-RESET: C95.2 R9.2 R21.2 U4.1 U5.13 U14.AJ11
AP-WAKE-BT: R69.2 U9.6 U14.U4
AXP717-CC1: D24.2 R130.2 USB3.A5
AXP717-CC2: D31.2 R129.2 USB3.B5
BLDO1: C59.1 C179.2 C180.2 R69.1 R70.1 U4.18 U9.22 U14.N9 U14.N24 U14.T9
BLDO2: C61.1 C136.2 C139.2 C140.2 U4.19 U5.14 UD1.F1 UD1.F12 UD1.G4 UD1.G9 UD1.T4 UD1.T9 UD1.U1 UD1.U12
BLDO3: C63.1 U4.21 U14.AJ5 U14.J15 U14.K13 U14.L22 U14.M10 U14.M21
BLDO4: C65.1 U4.22
BOOT-SEL-ADC: R30.1 R33.2 U14.W1
BT-RESETN: U9.34 U14.U3
BT-WAKE-AP: R70.2 U9.7 U14.U5
CAN-RX0: U14.AJ17
CAN-TX0: U14.AH17
CLDO1: C60.2 U4.23 U8.C6 U8.M4 U8.N4 U8.P3 U8.P5 U14.U26
CLDO2: C62.2 U4.24 U14.R26
CLDO3: C64.2 R47.1 U4.26 U8.E6 U8.F5 U8.J10 U8.K9 U14.AC9
CLDO4: C66.2 U4.27
CPUSLDO: C35.2 U4.28 U14.AC15
CPUX-RX: D30.2 H1.10 U14.R29 USB3.B8
CPUX-TX: D27.2 H1.8 U14.R28 USB3.A8
CPVDD: U14.AJ3
CPVEE: U14.AJ4 U14.AK2
CTP-INT: U14.R31
CTP-RST: U14.R30
CTP-SCK: U14.R32
CTP-SDA: U14.R33
DCDC1: C15.2 C16.2 L2.2 U14.W19 U14.W21 U14.Y19 U14.Y21
DCDC2: C18.2 C25.2 C210.2 C218.2 C290.2 C291.2 L3.2 U14.J16 U14.L18 U14.L21 U14.M22 U14.N13 U14.N21 U14.P13 U14.P21 U14.P22 U14.R15 U14.R17 U14.R18 U14.T11 U14.T13 U14.U12 U14.U13
DCDC3: C31.2 C33.2 C131.2 C146.2 C147.1 C148.2 C149.2 C150.2 C157.2 C158.2 C159.2 C160.2 C292.2 C293.2 L4.2 R36.2 R37.2 U4.29 U14.AA24 U14.AB24 U14.AC17 U14.AC18 U14.AC19 U14.AC20 U14.AC22 U14.AC24 U14.W23 U14.W24 U14.W25 U14.Y24 UD1.A4 UD1.A9 UD1.AA3 UD1.AA5 UD1.AA8 UD1.AA10 UD1.AB4 UD1.AB9 UD1.B3 UD1.B5 UD1.B8 UD1.B10 UD1.D1 UD1.D5 UD1.D8 UD1.D12 UD1.F3 UD1.F5 UD1.F8 UD1.F10 UD1.H1 UD1.H5 UD1.H8 UD1.H12 UD1.K1 UD1.K3 UD1.K10 UD1.K12 UD1.N1 UD1.N3 UD1.N10 UD1.N12 UD1.R1 UD1.R5 UD1.R8 UD1.R12 UD1.U3 UD1.U5 UD1.U8 UD1.U10 UD1.W1 UD1.W5 UD1.W8 UD1.W12
DCIN-5V: C5.2 C6.2 D3.1 L1.2 R3.2
DCIN-12V: C1.2 C2.2 C7.2 Q1.2 R1.2 R4.2 U1.1 U2.1 U3.2
DCXO-XIN: C99.2 U14.AM13 X1.1
DCXO-XOUT: C98.2 U14.AN13 X1.3
DDR-PARA-SEL-ADC1: R31.1 R34.2 U14.W2
DDR-PARA-SEL-ADC2: R32.1 R35.2 U14.W3
DSP-UART-RX: H1.40 U14.AN2
DSP-UART-TX: H1.37 U14.AN3
EDP-AUXN: C199.1 U14.C33
EDP-AUXP: C198.1 U14.C32
EDP-HPD: D12.4 D12.7 R60.2 U14.C29 U15.18
EDP-TX0N: C191.1 U14.B29
EDP-TX0P: C190.1 U14.A29
EDP-TX1N: C193.1 U14.B30
EDP-TX1P: C192.1 U14.A30
EDP-TX2N: C195.1 U14.B31
EDP-TX2P: C194.1 U14.A31
EDP-TX3N: C197.1 U14.B33
EDP-TX3P: C196.1 U14.B32
EMMC-VDDI: U8.C2
FEL: C96.2 R22.2 U14.F16
GM0_DVDD10: C253.1 C254.1 C265.1 C266.1 C267.1 C268.2 L9.2 U12.3 U12.8 U12.21 U12.38
GM0_INTB: R88.2 U12.31
GM0_LED0: R92.1 U12.32
GM0_LED1: R80.2 R94.2 U12.33
GM0_LED2: R79.1 R96.2 U12.34
GM0_MDIN0: RJ1.P3 U12.2
GM0_MDIN1: RJ1.P7 U12.5
GM0_MDIN2: RJ1.P6 U12.7
GM0_MDIN3: RJ1.P9 U12.10
GM0_MDIP0: RJ1.P2 U12.1
GM0_MDIP1: RJ1.P4 U12.4
GM0_MDIP2: RJ1.P5 U12.6
GM0_MDIP3: RJ1.P8 U12.9
GM0_REGOUT: L9.1 U12.30
GM0_RSET: R85.2 U12.39
GM0_XTAL_IN: C252.2 U12.36 X3.1
GM0_XTAL_OUT: C251.2 U12.37 X3.3
GM1_DVDD10: C260.1 C261.1 C272.1 C273.1 C274.1 C275.2 L10.2 U13.3 U13.8 U13.21 U13.38
GM1_DVDDRG: C249.1 C250.1 C256.1 C258.1 C262.1 C263.1 C264.1 C269.1 C270.1 C271.1 H1.1 H1.17 L5.1 R14.1 R17.2 R61.1 R83.1 R88.1 R89.2 R90.1 R91.2 R92.2 R101.1 R106.1 R107.2 R108.1 R109.2 R110.2 R124.2 R125.2 RJ1.11 RJ1.14 RJ2.11 RJ2.14 TFT1.10 U9.9 U12.11 U12.28 U12.29 U12.40 U13.11 U13.28 U13.29 U13.40 U14.AE16 U14.J18 U14.J19 U14.K19 U14.L9 U14.L15 U14.L17 U14.L26 U14.P9 U15.20
GM1_INTB: R106.2 U13.31
GM1_LED0: R110.1 U13.32
GM1_LED1: R98.2 R112.2 U13.33
GM1_LED2: R97.1 R114.2 U13.34
GM1_MDIN0: RJ2.P3 U13.2
GM1_MDIN1: RJ2.P7 U13.5
GM1_MDIN2: RJ2.P6 U13.7
GM1_MDIN3: RJ2.P9 U13.10
GM1_MDIP0: RJ2.P2 U13.1
GM1_MDIP1: RJ2.P4 U13.4
GM1_MDIP2: RJ2.P5 U13.6
GM1_MDIP3: RJ2.P8 U13.9
GM1_REGOUT: L10.1 U13.30
GM1_RSET: R103.2 U13.39
GM1_XTAL_IN: C259.2 U13.36 X4.1
GM1_XTAL_OUT: C257.2 U13.37 X4.3
HBIAS: U14.AL1
HCEC: D7.1 R48.1 U14.E28
HHPD: C189.2 R54.1 U14.D28
HP-DET: CN2.3 U14.AJ2
HPOUTFB: CN2.6 U14.AM1
HPOUTL: CN2.5 U14.AL2
HPOUTR: CN2.2 U14.AM2
HREXT: U14.F26
HS-MIC: CN2.4
HSCL: R50.1 U14.D26
HSDA: R51.1 U14.E26
HTX0N: D6.2 D6.9 U14.C27 USB1.9
HTX0P: D6.1 D6.10 U14.B27 USB1.7
HTX1N: D5.5 D5.6 U14.B26 USB1.6
HTX1P: D5.4 D5.7 U14.A26 USB1.4
HTX2N: D5.2 D5.9 U14.C25 USB1.3
HTX2P: D5.1 D5.10 U14.B25 USB1.1
HTXCN: D6.5 D6.6 U14.B28 USB1.12
HTXCP: D6.4 D6.7 U14.A28 USB1.10
IR-RX: CGQ1.3 R124.1 U14.AL16
LCD0-CLK: U14.K31
LCD0-D0: U14.N28
LCD0-D1: U14.N29
LCD0-D2: U14.D32
LCD0-D3: U14.D33
LCD0-D4: U14.E30
LCD0-D5: U14.E31
LCD0-D6: U14.E32
LCD0-D7: U14.E33
LCD0-D8: U14.M31
LCD0-D9: U14.M32
LCD0-D10: U14.F32
LCD0-D11: U14.F33
LCD0-D12: U14.G30
LCD0-D13: U14.G31
LCD0-D14: U14.G32
LCD0-D15: U14.G33
LCD0-D16: U14.P31
LCD0-D17: U14.P32
LCD0-D18: U14.H31
LCD0-D19: U14.H32
LCD0-D20: U14.J29
LCD0-D21: U14.J30
LCD0-D22: U14.J32
LCD0-D23: U14.J33
LCD0-DE: U14.K32
LCD0-HSYNC: U14.L28
LCD0-PWM: U14.L31
LCD0-RST: U14.L32
LCD0-VSYNC: U14.L29
LEDC: LED2.3 U14.C13
MCSI0-CKN: U14.A10
MCSI0-CKP: U14.B10
MCSI0-D0N: U14.A12
MCSI0-D0P: U14.B12
MCSI0-D1N: U14.B11
MCSI0-D1P: U14.C11
MCSI0-D2N: U14.E12
MCSI0-D2P: U14.D12
MCSI0-D3N: U14.E10
MCSI0-D3P: U14.D10
MCSI0-MCLK: U14.A6
MCSI0-PWDN: U14.B4
MCSI0-RSTN: U14.A4
MCSI0-SCK: U14.E8
MCSI0-SDA: U14.D8
MCSI0-USER: U14.B5
MICIN3N: U14.AF1
MICIN3P: U14.AF2
PE0: H1.12 U14.E6
PE1: H1.21 U14.C4
PE2: H1.13 U14.E5
PE3: H1.16 U14.E4
PE4: H1.15 U14.C3
PE5: H1.22 U14.B3
PE6: H1.19 U14.A3
PE7: H1.24 U14.A2
PE8: H1.23 U14.B2
PE9: H1.18 U14.B1
PE10: H1.27 U14.C2
PE11: H1.7 U14.J7
PE12: H1.26 U14.C1
PE13: H1.11 U14.G6
PE14: H1.5 U14.L7
PE15: H1.3 U14.N7
PGAOUT0: U14.U8
PGAOUT1: U14.U10
PHYRSTB0: R90.2 U12.12 U14.D16
PHYRSTB1: R108.2 U13.12 U14.J1
PMU-SCK: R11.2 U4.52 U5.6 U14.AN6
PMU-SDA: R12.2 U4.51 U5.5 U14.AN5
PS: C12.1 C17.1 C55.1 C70.2 C283.2 C284.2 U4.9 U4.15 U4.20 U4.25 U4.31 U4.32 U4.43 U4.44 U4.47 U4.48 U5.2 U5.17 U5.20
PWRON: C11.1 C97.2 R23.2 U4.6
RF: C244.2 R72.1 U9.2
RGMII0-CLKIN: U12.35 U14.C17
RGMII0-MDC: U12.13 U14.C16
RGMII0-MDIO: R83.2 U12.14 U14.B16
RGMII0-RXCK: R93.2 U12.27 U14.B14
RGMII0-RXCTL: R95.2 U12.26 U14.D18
RGMII0-RXD0: R89.1 U12.25 U14.E18
RGMII0-RXD1: R86.2 U12.24 U14.F18
RGMII0-RXD2: R82.2 U12.23 U14.D14
RGMII0-RXD3: R91.1 U12.22 U14.E14
RGMII0-TXCK: U12.20 U14.G12
RGMII0-TXCTL: U12.19 U14.F14
RGMII0-TXD0: U12.18 U14.E16
RGMII0-TXD1: U12.17 U14.B17
RGMII0-TXD2: U12.16 U14.A14
RGMII0-TXD3: U12.15 U14.B13
RGMII1-CLKIN: U13.35 U14.E2
RGMII1-MDC: U13.13 U14.H2
RGMII1-MDIO: R101.2 U13.14 U14.H3
RGMII1-RXCK: R111.2 U13.27 U14.J5
RGMII1-RXCTL: R113.2 U13.26 U14.E1
RGMII1-RXD0: R107.1 U13.25 U14.D2
RGMII1-RXD1: R104.2 U13.24 U14.D1
RGMII1-RXD2: R100.2 U13.23 U14.J4
RGMII1-RXD3: R109.1 U13.22 U14.G5
RGMII1-TXCK: U13.20 U14.G1
RGMII1-TXCTL: U13.19 U14.G2
RGMII1-TXD0: U13.18 U14.F2
RGMII1-TXD1: U13.17 U14.F1
RGMII1-TXD2: U13.16 U14.L5
RGMII1-TXD3: U13.15 U14.L4
SAA0: U14.AJ33 UD1.H2
SAA1: U14.AJ32 UD1.J2
SAA2: U14.AG30 UD1.H9
SAA3: U14.AG29 UD1.H10
SAA4: U14.AJ30 UD1.H11
SAA5: U14.AJ31 UD1.J11
SAB0: U14.AJ25 UD1.R2
SAB1: U14.AH25 UD1.P2
SAB2: U14.AL25 UD1.R9
SAB3: U14.AK25 UD1.R10
SAB4: U14.AJ27 UD1.R11
SAB5: U14.AL29 UD1.P11
SCKE0-A: U14.AM31 UD1.J4
SCKE0-B: U14.AN27 UD1.P4
SCKE1-A: U14.AL31 UD1.J5
SCKE1-B: U14.AM27 UD1.P5
SCKN-A: U14.AN30 UD1.J9
SCKN-B: U14.AN29 UD1.P9
SCKP-A: U14.AM30 UD1.J8
SCKP-B: U14.AM28 UD1.P8
SCS0-A: U14.AN32 UD1.H4
SCS0-B: U14.AK29 UD1.R4
SCS1-A: U14.AM32 UD1.H3
SCS1-B: U14.AK27 UD1.R3
SDC0-CLK: R42.2
SDC0-CMD: U14.B19
SDC0-D0: U14.A20
SDC0-D1: U14.B20
SDC0-D2: U14.A18
SDC0-D3: U14.B18
SDC0-DET: U14.D20
SDC1-CLK: R43.2 U9.17
SDC1-CMD: U9.16 U14.R2
SDC1-D0: U9.18 U14.P3
SDC1-D1: U9.19 U14.P2
SDC1-D2: U9.14 U14.T3
SDC1-D3: U9.15 U14.T2
SDC2-CLK: R41.1 U8.M6
SDC2-CMD: U8.M5 U14.W33
SDC2-D0: U8.A3 U14.V32
SDC2-D1: U8.A4 U14.U32
SDC2-D2: U8.A5 U14.T32
SDC2-D3: U8.B2 U14.W32
SDC2-D4: U8.B3 U14.W31
SDC2-D5: U8.B4 U14.V31
SDC2-D6: U8.B5 U14.U31
SDC2-D7: U8.B6 U14.T31
SDC2-DS: U8.H5 U14.W28
